# Altium schematic sheet Intel16_UNI3_Q4.SchDoc
size A3; SheetNumber: 8; SheetTotal: 15
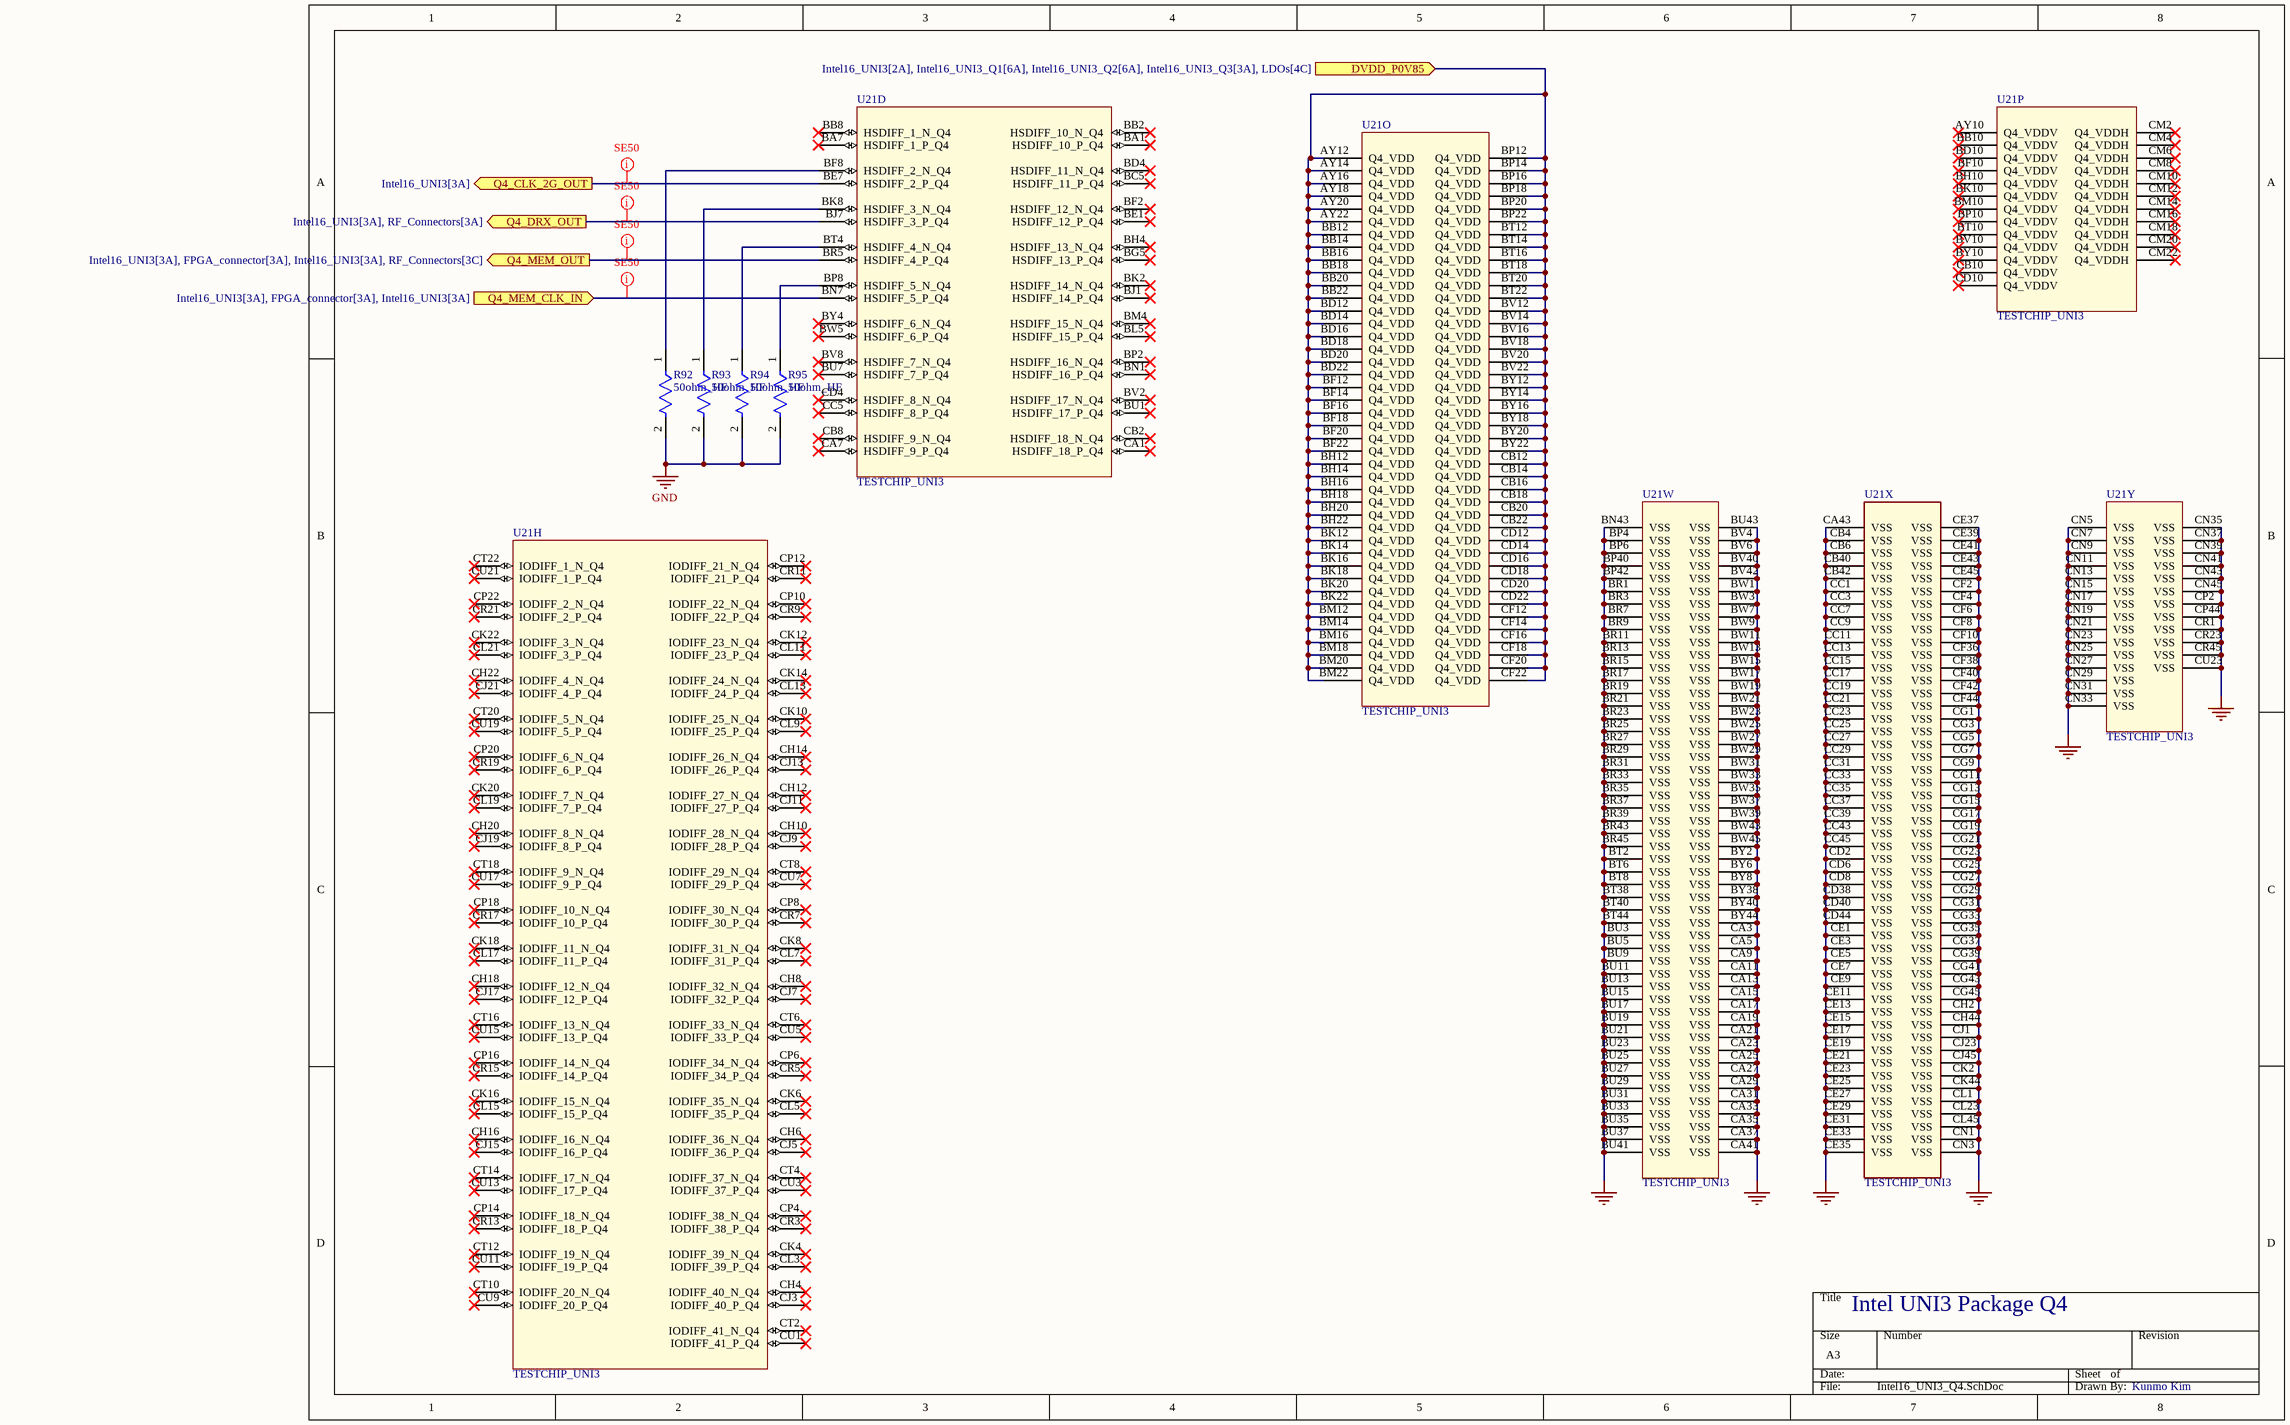
[diagram p0: Intel16_UNI3_Q4.SchDoc]

## Parts
R92  50ohm_HF  [FP-RC0100-0_15-MFG]
R93  50ohm_HF  [FP-RC0100-0_15-MFG]
R94  50ohm_HF  [FP-RC0100-0_15-MFG]
R95  50ohm_HF  [FP-RC0100-0_15-MFG]
U21  TESTCHIP_UNI3  [BGA-1733-.92-37.5X37.5]  (parts D,H,O,P,W,X,Y of 25)

## Ports
DVDD_P0V85 (in, see Intel16_UNI3[2A], Intel16_UNI3_Q1[6A], Intel16_UNI3_Q2[6A], Intel16_UNI3_Q3[3A], LDOs[4C]), Q4_CLK_2G_OUT (out, see Intel16_UNI3[3A]), Q4_DRX_OUT (out, see Intel16_UNI3[3A], RF_Connectors[3A]), Q4_MEM_CLK_IN (in, see Intel16_UNI3[3A], FPGA_connector[3A], Intel16_UNI3[3A]), Q4_MEM_OUT (out, see Intel16_UNI3[3A], FPGA_connector[3A], Intel16_UNI3[3A], RF_Connectors[3C])

## Nets
GND: R92.2 R93.2 R94.2 R95.2 U21.BN43(VSS) U21.BP4(VSS) U21.BP6(VSS) U21.BP40(VSS) U21.BP42(VSS) U21.BR1(VSS) U21.BR3(VSS) U21.BR7(VSS) U21.BR9(VSS) U21.BR11(VSS) U21.BR13(VSS) U21.BR15(VSS) U21.BR17(VSS) U21.BR19(VSS) U21.BR21(VSS) U21.BR23(VSS) U21.BR25(VSS) U21.BR27(VSS) U21.BR29(VSS) U21.BR31(VSS) U21.BR33(VSS) U21.BR35(VSS) U21.BR37(VSS) U21.BR39(VSS) U21.BR43(VSS) U21.BR45(VSS) U21.BT2(VSS) U21.BT6(VSS) U21.BT8(VSS) U21.BT38(VSS) U21.BT40(VSS) U21.BT44(VSS) U21.BU3(VSS) U21.BU5(VSS) U21.BU9(VSS) U21.BU11(VSS) U21.BU13(VSS) U21.BU15(VSS) U21.BU17(VSS) U21.BU19(VSS) U21.BU21(VSS) U21.BU23(VSS) U21.BU25(VSS) U21.BU27(VSS) U21.BU29(VSS) U21.BU31(VSS) U21.BU33(VSS) U21.BU35(VSS) U21.BU37(VSS) U21.BU41(VSS) U21.BU43(VSS) U21.BV4(VSS) U21.BV6(VSS) U21.BV40(VSS) U21.BV42(VSS) U21.BW1(VSS) U21.BW3(VSS) U21.BW7(VSS) U21.BW9(VSS) U21.BW11(VSS) U21.BW13(VSS) U21.BW15(VSS) U21.BW17(VSS) U21.BW19(VSS) U21.BW21(VSS) U21.BW23(VSS) U21.BW25(VSS) U21.BW27(VSS) U21.BW29(VSS) U21.BW31(VSS) U21.BW33(VSS) U21.BW35(VSS) U21.BW37(VSS) U21.BW39(VSS) U21.BW43(VSS) U21.BW45(VSS) U21.BY2(VSS) U21.BY6(VSS) U21.BY8(VSS) U21.BY38(VSS) U21.BY40(VSS) U21.BY44(VSS) U21.CA3(VSS) U21.CA5(VSS) U21.CA9(VSS) U21.CA11(VSS) U21.CA13(VSS) U21.CA15(VSS) U21.CA17(VSS) U21.CA19(VSS) U21.CA21(VSS) U21.CA23(VSS) U21.CA25(VSS) U21.CA27(VSS) U21.CA29(VSS) U21.CA31(VSS) U21.CA33(VSS) U21.CA35(VSS) U21.CA37(VSS) U21.CA41(VSS) U21.CA43(VSS) U21.CB4(VSS) U21.CB6(VSS) U21.CB40(VSS) U21.CB42(VSS) U21.CC1(VSS) U21.CC3(VSS) U21.CC7(VSS) U21.CC9(VSS) U21.CC11(VSS) U21.CC13(VSS) U21.CC15(VSS) U21.CC17(VSS) U21.CC19(VSS) U21.CC21(VSS) U21.CC23(VSS) U21.CC25(VSS) U21.CC27(VSS) U21.CC29(VSS) U21.CC31(VSS) U21.CC33(VSS) U21.CC35(VSS) U21.CC37(VSS) U21.CC39(VSS) U21.CC43(VSS) U21.CC45(VSS) U21.CD2(VSS) U21.CD6(VSS) U21.CD8(VSS) U21.CD38(VSS) U21.CD40(VSS) U21.CD44(VSS) U21.CE1(VSS) U21.CE3(VSS) U21.CE5(VSS) U21.CE7(VSS) U21.CE9(VSS) U21.CE11(VSS) U21.CE13(VSS) U21.CE15(VSS) U21.CE17(VSS) U21.CE19(VSS) U21.CE21(VSS) U21.CE23(VSS) U21.CE25(VSS) U21.CE27(VSS) U21.CE29(VSS) U21.CE31(VSS) U21.CE33(VSS) U21.CE35(VSS) U21.CE37(VSS) U21.CE39(VSS) U21.CE41(VSS) U21.CE43(VSS) U21.CE45(VSS) U21.CF2(VSS) U21.CF4(VSS) U21.CF6(VSS) U21.CF8(VSS) U21.CF10(VSS) U21.CF36(VSS) U21.CF38(VSS) U21.CF40(VSS) U21.CF42(VSS) U21.CF44(VSS) U21.CG1(VSS) U21.CG3(VSS) U21.CG5(VSS) U21.CG7(VSS) U21.CG9(VSS) U21.CG11(VSS) U21.CG13(VSS) U21.CG15(VSS) U21.CG17(VSS) U21.CG19(VSS) U21.CG21(VSS) U21.CG23(VSS) U21.CG25(VSS) U21.CG27(VSS) U21.CG29(VSS) U21.CG31(VSS) U21.CG33(VSS) U21.CG35(VSS) U21.CG37(VSS) U21.CG39(VSS) U21.CG41(VSS) U21.CG43(VSS) U21.CG45(VSS) U21.CH2(VSS) U21.CH44(VSS) U21.CJ1(VSS) U21.CJ23(VSS) U21.CJ45(VSS) U21.CK2(VSS) U21.CK44(VSS) U21.CL1(VSS) U21.CL23(VSS) U21.CL45(VSS) U21.CN1(VSS) U21.CN3(VSS) U21.CN5(VSS) U21.CN7(VSS) U21.CN9(VSS) U21.CN11(VSS) U21.CN13(VSS) U21.CN15(VSS) U21.CN17(VSS) U21.CN19(VSS) U21.CN21(VSS) U21.CN23(VSS) U21.CN25(VSS) U21.CN27(VSS) U21.CN29(VSS) U21.CN31(VSS) U21.CN33(VSS) U21.CN35(VSS) U21.CN37(VSS) U21.CN39(VSS) U21.CN41(VSS) U21.CN43(VSS) U21.CN45(VSS) U21.CP2(VSS) U21.CP44(VSS) U21.CR1(VSS) U21.CR23(VSS) U21.CR45(VSS) U21.CU23(VSS)
DVDD_P0V85: U21.AY12(Q4_VDD) U21.AY14(Q4_VDD) U21.AY16(Q4_VDD) U21.AY18(Q4_VDD) U21.AY20(Q4_VDD) U21.AY22(Q4_VDD) U21.BB12(Q4_VDD) U21.BB14(Q4_VDD) U21.BB16(Q4_VDD) U21.BB18(Q4_VDD) U21.BB20(Q4_VDD) U21.BB22(Q4_VDD) U21.BD12(Q4_VDD) U21.BD14(Q4_VDD) U21.BD16(Q4_VDD) U21.BD18(Q4_VDD) U21.BD20(Q4_VDD) U21.BD22(Q4_VDD) U21.BF12(Q4_VDD) U21.BF14(Q4_VDD) U21.BF16(Q4_VDD) U21.BF18(Q4_VDD) U21.BF20(Q4_VDD) U21.BF22(Q4_VDD) U21.BH12(Q4_VDD) U21.BH14(Q4_VDD) U21.BH16(Q4_VDD) U21.BH18(Q4_VDD) U21.BH20(Q4_VDD) U21.BH22(Q4_VDD) U21.BK12(Q4_VDD) U21.BK14(Q4_VDD) U21.BK16(Q4_VDD) U21.BK18(Q4_VDD) U21.BK20(Q4_VDD) U21.BK22(Q4_VDD) U21.BM12(Q4_VDD) U21.BM14(Q4_VDD) U21.BM16(Q4_VDD) U21.BM18(Q4_VDD) U21.BM20(Q4_VDD) U21.BM22(Q4_VDD) U21.BP12(Q4_VDD) U21.BP14(Q4_VDD) U21.BP16(Q4_VDD) U21.BP18(Q4_VDD) U21.BP20(Q4_VDD) U21.BP22(Q4_VDD) U21.BT12(Q4_VDD) U21.BT14(Q4_VDD) U21.BT16(Q4_VDD) U21.BT18(Q4_VDD) U21.BT20(Q4_VDD) U21.BT22(Q4_VDD) U21.BV12(Q4_VDD) U21.BV14(Q4_VDD) U21.BV16(Q4_VDD) U21.BV18(Q4_VDD) U21.BV20(Q4_VDD) U21.BV22(Q4_VDD) U21.BY12(Q4_VDD) U21.BY14(Q4_VDD) U21.BY16(Q4_VDD) U21.BY18(Q4_VDD) U21.BY20(Q4_VDD) U21.BY22(Q4_VDD) U21.CB12(Q4_VDD) U21.CB14(Q4_VDD) U21.CB16(Q4_VDD) U21.CB18(Q4_VDD) U21.CB20(Q4_VDD) U21.CB22(Q4_VDD) U21.CD12(Q4_VDD) U21.CD14(Q4_VDD) U21.CD16(Q4_VDD) U21.CD18(Q4_VDD) U21.CD20(Q4_VDD) U21.CD22(Q4_VDD) U21.CF12(Q4_VDD) U21.CF14(Q4_VDD) U21.CF16(Q4_VDD) U21.CF18(Q4_VDD) U21.CF20(Q4_VDD) U21.CF22(Q4_VDD) ; port DVDD_P0V85
Q4_CLK_2G_OUT: U21.BE7(HSDIFF_2_P_Q4) ; port Q4_CLK_2G_OUT
Q4_DRX_OUT: U21.BJ7(HSDIFF_3_P_Q4) ; port Q4_DRX_OUT
Q4_MEM_CLK_IN: U21.BN7(HSDIFF_5_P_Q4) ; port Q4_MEM_CLK_IN
Q4_MEM_OUT: U21.BR5(HSDIFF_4_P_Q4) ; port Q4_MEM_OUT
NetR92_1: R92.1 U21.BF8(HSDIFF_2_N_Q4)
NetR93_1: R93.1 U21.BK8(HSDIFF_3_N_Q4)
NetR94_1: R94.1 U21.BT4(HSDIFF_4_N_Q4)
NetR95_1: R95.1 U21.BP8(HSDIFF_5_N_Q4)

Not connected (* = marked no-connect by the designer): U21 AY10(Q4_VDDV)* BA1(HSDIFF_10_P_Q4)* BA7(HSDIFF_1_P_Q4)* BB2(HSDIFF_10_N_Q4)* BB8(HSDIFF_1_N_Q4)* BB10(Q4_VDDV)* BC5(HSDIFF_11_P_Q4)* BD4(HSDIFF_11_N_Q4)* BD10(Q4_VDDV)* BE1(HSDIFF_12_P_Q4)* BF2(HSDIFF_12_N_Q4)* BF10(Q4_VDDV)* BG5(HSDIFF_13_P_Q4)* BH4(HSDIFF_13_N_Q4)* BH10(Q4_VDDV)* BJ1(HSDIFF_14_P_Q4)* BK2(HSDIFF_14_N_Q4)* BK10(Q4_VDDV)* BL5(HSDIFF_15_P_Q4)* BM4(HSDIFF_15_N_Q4)* BM10(Q4_VDDV)* BN1(HSDIFF_16_P_Q4)* BP2(HSDIFF_16_N_Q4)* BP10(Q4_VDDV)* BT10(Q4_VDDV)* BU1(HSDIFF_17_P_Q4)* BU7(HSDIFF_7_P_Q4)* BV2(HSDIFF_17_N_Q4)* BV8(HSDIFF_7_N_Q4)* BV10(Q4_VDDV)* BW5(HSDIFF_6_P_Q4)* BY4(HSDIFF_6_N_Q4)* BY10(Q4_VDDV)* CA1(HSDIFF_18_P_Q4)* CA7(HSDIFF_9_P_Q4)* CB2(HSDIFF_18_N_Q4)* CB8(HSDIFF_9_N_Q4)* CB10(Q4_VDDV)* CC5(HSDIFF_8_P_Q4)* CD4(HSDIFF_8_N_Q4)* CD10(Q4_VDDV)* CH4(IODIFF_40_N_Q4)* CH6(IODIFF_36_N_Q4)* CH8(IODIFF_32_N_Q4)* CH10(IODIFF_28_N_Q4)* CH12(IODIFF_27_N_Q4)* CH14(IODIFF_26_N_Q4)* CH16(IODIFF_16_N_Q4)* CH18(IODIFF_12_N_Q4)* CH20(IODIFF_8_N_Q4)* CH22(IODIFF_4_N_Q4)* CJ3(IODIFF_40_P_Q4)* CJ5(IODIFF_36_P_Q4)* CJ7(IODIFF_32_P_Q4)* CJ9(IODIFF_28_P_Q4)* CJ11(IODIFF_27_P_Q4)* CJ13(IODIFF_26_P_Q4)* CJ15(IODIFF_16_P_Q4)* CJ17(IODIFF_12_P_Q4)* CJ19(IODIFF_8_P_Q4)* CJ21(IODIFF_4_P_Q4)* CK4(IODIFF_39_N_Q4)* CK6(IODIFF_35_N_Q4)* CK8(IODIFF_31_N_Q4)* CK10(IODIFF_25_N_Q4)* CK12(IODIFF_23_N_Q4)* CK14(IODIFF_24_N_Q4)* CK16(IODIFF_15_N_Q4)* CK18(IODIFF_11_N_Q4)* CK20(IODIFF_7_N_Q4)* CK22(IODIFF_3_N_Q4)* CL3(IODIFF_39_P_Q4)* CL5(IODIFF_35_P_Q4)* CL7(IODIFF_31_P_Q4)* CL9(IODIFF_25_P_Q4)* CL11(IODIFF_23_P_Q4)* CL13(IODIFF_24_P_Q4)* CL15(IODIFF_15_P_Q4)* CL17(IODIFF_11_P_Q4)* CL19(IODIFF_7_P_Q4)* CL21(IODIFF_3_P_Q4)* CM2(Q4_VDDH)* CM4(Q4_VDDH)* CM6(Q4_VDDH)* CM8(Q4_VDDH)* CM10(Q4_VDDH)* CM12(Q4_VDDH)* CM14(Q4_VDDH)* CM16(Q4_VDDH)* CM18(Q4_VDDH)* CM20(Q4_VDDH)* CM22(Q4_VDDH)* CP4(IODIFF_38_N_Q4)* CP6(IODIFF_34_N_Q4)* CP8(IODIFF_30_N_Q4)* CP10(IODIFF_22_N_Q4)* CP12(IODIFF_21_N_Q4)* CP14(IODIFF_18_N_Q4)* CP16(IODIFF_14_N_Q4)* CP18(IODIFF_10_N_Q4)* CP20(IODIFF_6_N_Q4)* CP22(IODIFF_2_N_Q4)* CR3(IODIFF_38_P_Q4)* CR5(IODIFF_34_P_Q4)* CR7(IODIFF_30_P_Q4)* CR9(IODIFF_22_P_Q4)* CR11(IODIFF_21_P_Q4)* CR13(IODIFF_18_P_Q4)* CR15(IODIFF_14_P_Q4)* CR17(IODIFF_10_P_Q4)* CR19(IODIFF_6_P_Q4)* CR21(IODIFF_2_P_Q4)* CT2(IODIFF_41_N_Q4)* CT4(IODIFF_37_N_Q4)* CT6(IODIFF_33_N_Q4)* CT8(IODIFF_29_N_Q4)* CT10(IODIFF_20_N_Q4)* CT12(IODIFF_19_N_Q4)* CT14(IODIFF_17_N_Q4)* CT16(IODIFF_13_N_Q4)* CT18(IODIFF_9_N_Q4)* CT20(IODIFF_5_N_Q4)* CT22(IODIFF_1_N_Q4)* CU1(IODIFF_41_P_Q4)* CU3(IODIFF_37_P_Q4)* CU5(IODIFF_33_P_Q4)* CU7(IODIFF_29_P_Q4)* CU9(IODIFF_20_P_Q4)* CU11(IODIFF_19_P_Q4)* CU13(IODIFF_17_P_Q4)* CU15(IODIFF_13_P_Q4)* CU17(IODIFF_9_P_Q4)* CU19(IODIFF_5_P_Q4)* CU21(IODIFF_1_P_Q4)*

## Layout directives
net class SE50: Q4_CLK_2G_OUT, Q4_DRX_OUT, Q4_MEM_CLK_IN, Q4_MEM_OUT

## Notes on the sheet
- Intel UNI3 Package Q4
- Kunmo Kim

## Library data of the parts
R92-R95 = yageo_50ohm: RES SMD 49.9 OHM 1% 1/32W 01005; Resistance: 113R; Max Power Dissipation: 30mW; Temperature Coefficient: 200ppm/°C; Length: 0.016inch; Resistor Type: Thick Film; Tolerance: 1%; Height: 0.006inch; RoHS Compliant: Yes; Case Code (Imperial): 1005; Width: 0.008inch; Packaging: Tape and Reel; Case Code (Metric): 0402; Min Operating Temperature: -55°C; Max Operating Temperature: 125°C; Features: Moisture Resistant; Number of Terminations: 2; Supplier 1: Digikey; Supplier Part Number 1: YAG6363CT-ND
U21 = TESTCHIP_UNI2: UNI2 interposer